# EasyEDA Pro project RCKid3.eprj, board RCKid (continued)
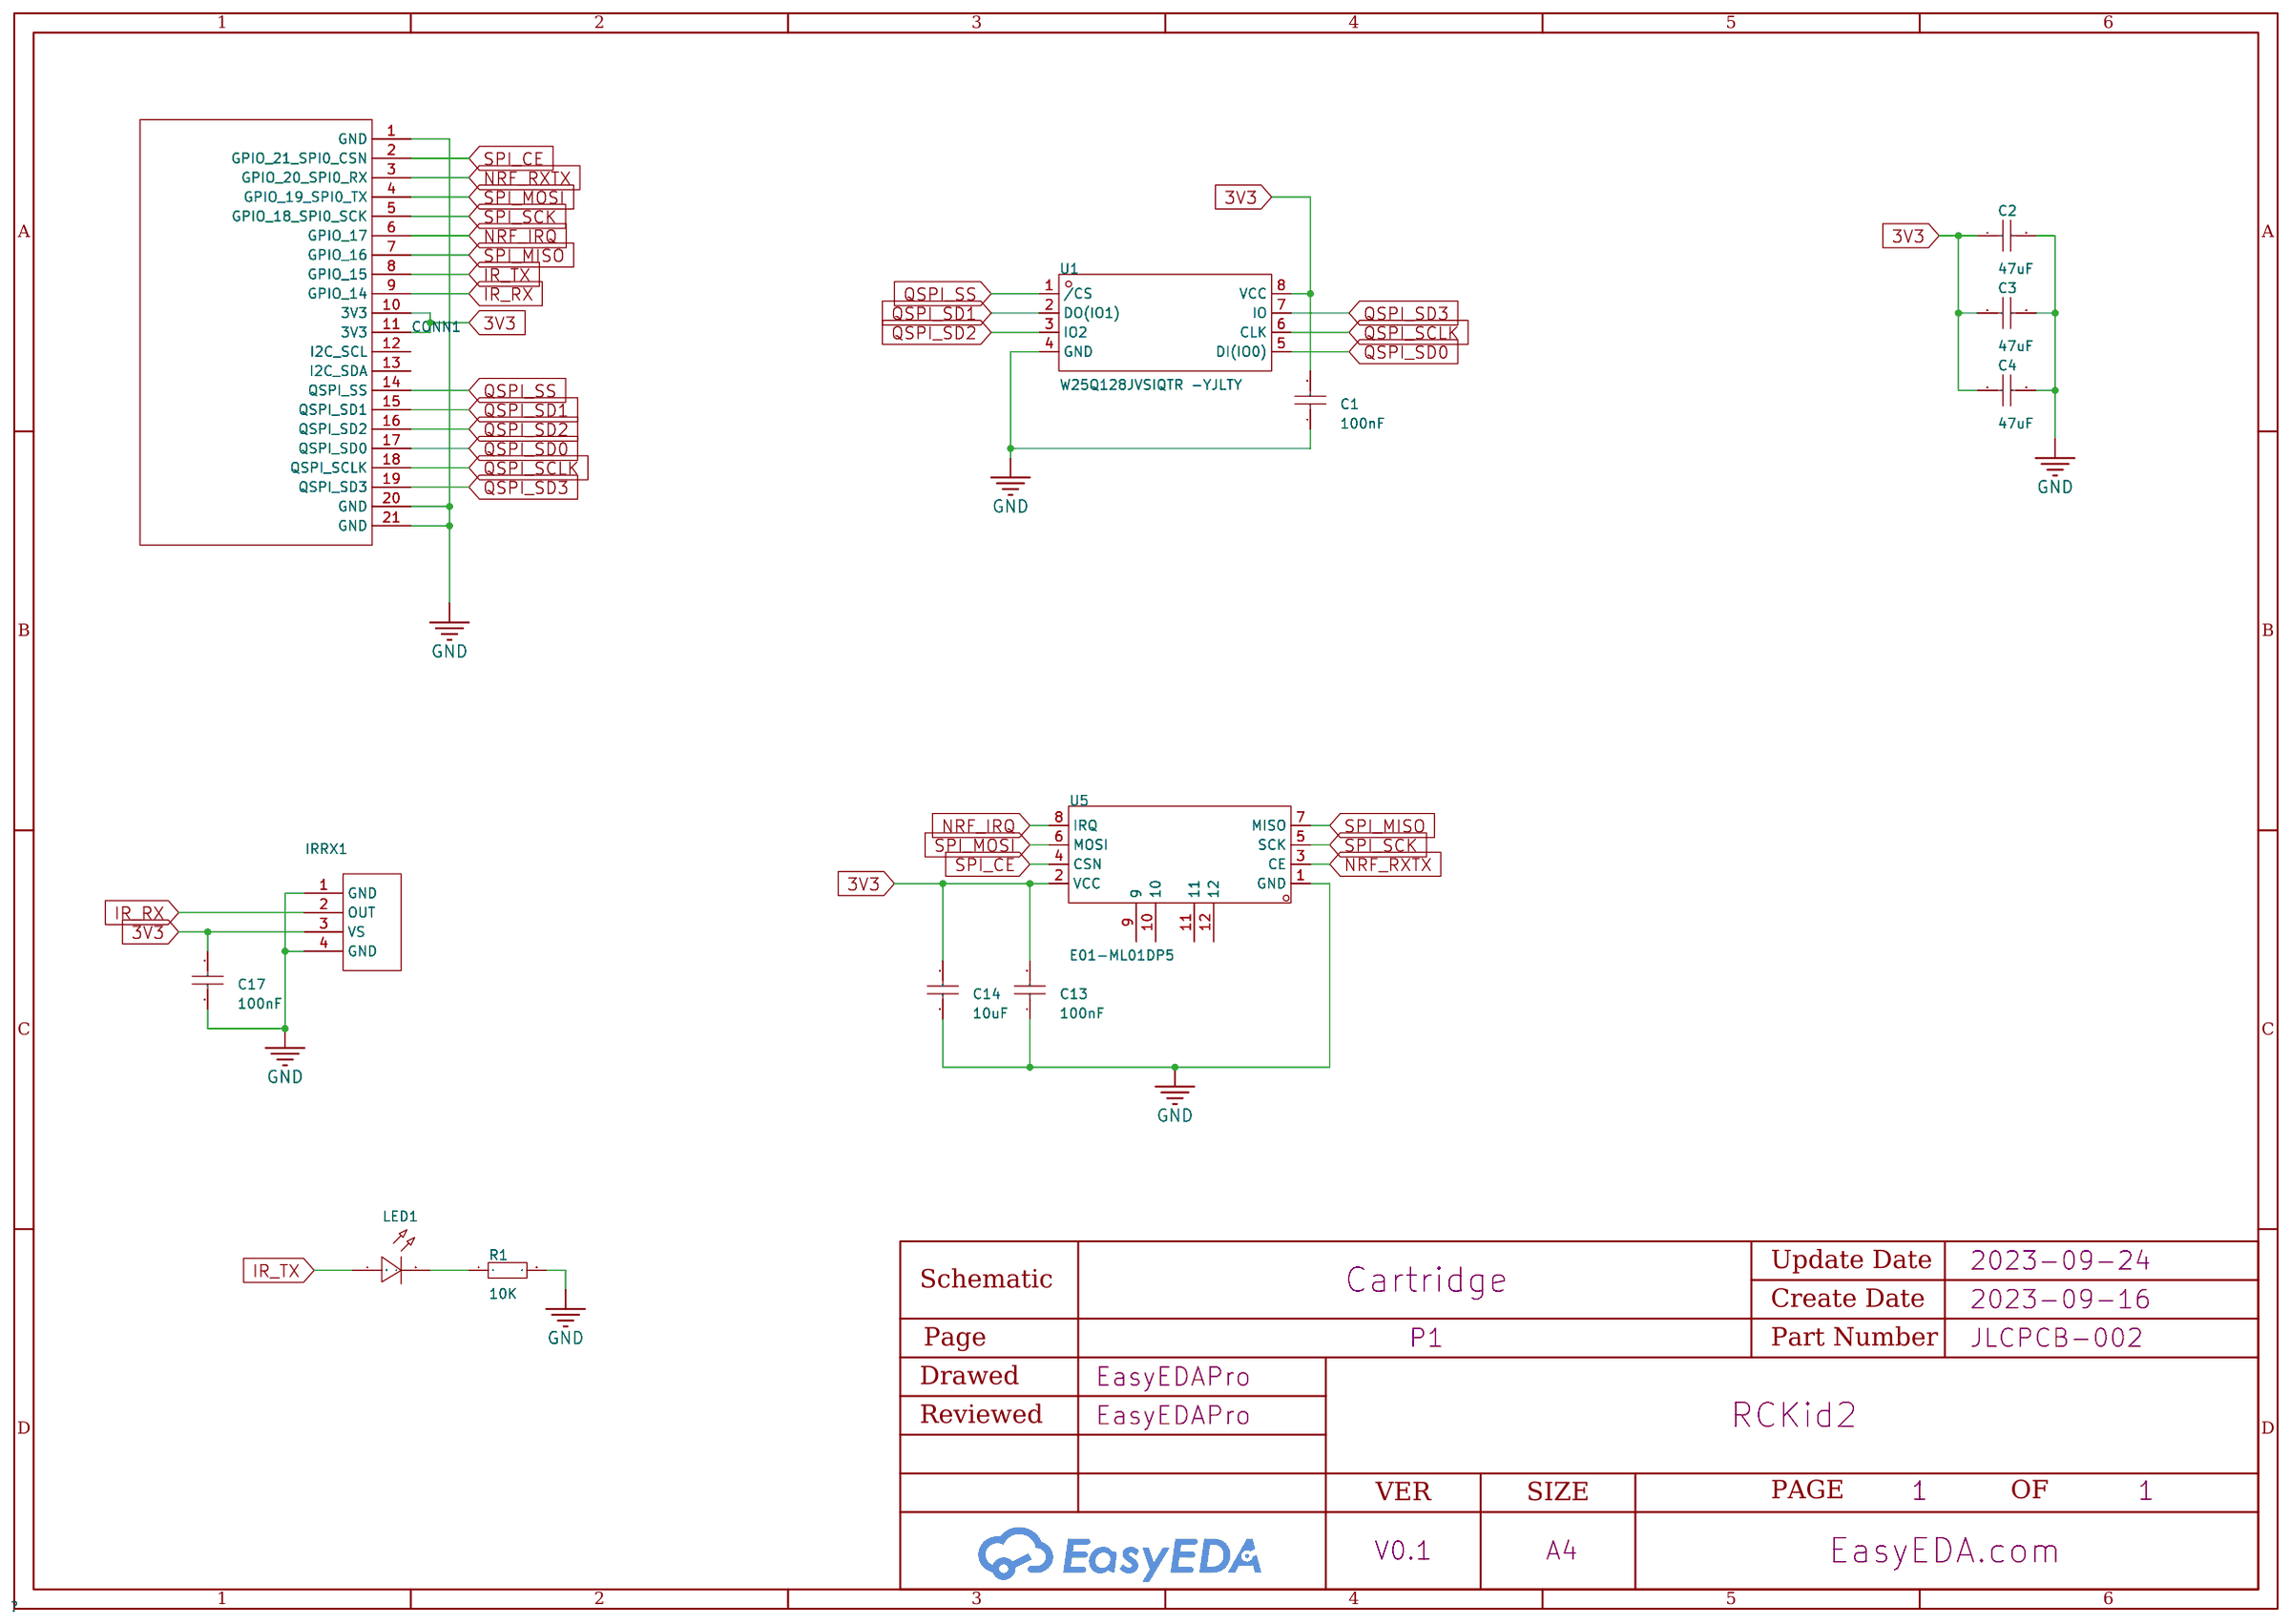
[diagram p0: NRF24L01P]
## Routing (per net, layer and track width the routed paths; a pad name or vN(x,y) marks a point on that pad's centre or on a via; arc(x,y) is an arc through that point) (continued)
  Bottom Layer w0.15: v1(63.7,38.89) 66,36.59 VOL_DOWN.2 ; VOL_UP.2 v1(63.7,42.99) 58.3,48.39 55.9,48.39 53.9,50.39 v1(44.5,50.39)
  Bottom Layer w0.2: v1(66,57.19) HOME1.1
BTN_DPAD: length 44.7
  Top Layer w0.15: AVR.19 30.65,49.44 30.2,49.89 26,49.89 v1(25.4,49.29) ; LEFT1.2 LEFT1.4
  Top Layer w0.2: RIGHT1.2 16.7,36.54 18.65,38.49 BOTTOM1.4 BOTTOM1.2 18.65,44.49 16.7,46.44 LEFT1.4 ; LEFT1.2 10.7,46.44 8.75,44.49 TOP1.4 TOP1.2 8.75,38.49 10.7,36.54 RIGHT1.4
  Bottom Layer w0.15: v1(25.4,49.29) 21.6,45.49 v1(17.7,45.49)
DB_0: length 60.7
  Top Layer w0.15: RP2350B.44 6.27,81.59 5.3,82.56 5.3,86.09 7.2,87.99 7.2,94.59 9.6,96.99 19.6,96.99 21.5,95.09 30.5,95.09 42.8,82.79 43.77,82.79 DISPLAY.24
DB_1: length 59.3
  Top Layer w0.15: RP2350B.43 6.43,81.99 5.7,82.72 5.7,85.69 7.8,87.79 7.8,94.39 10,96.59 19.2,96.59 21.3,94.49 30.3,94.49 42.55,82.24 DISPLAY.23
DB_2: length 57.9
  Top Layer w0.15: DISPLAY.22 42.25,81.74 30.1,93.89 21.1,93.89 18.8,96.19 10.4,96.19 8.4,94.19 8.4,87.59 6.1,85.29 6.1,82.89 6.6,82.39 RP2350B.42
DB_3: length 52.3
  Top Layer w0.15: RP2350B.40 10.4,84.39 9,85.79 9,93.99 10.8,95.79 18.4,95.79 20.9,93.29 29.9,93.29 41.95,81.24 DISPLAY.21
DB_4: length 51.3
  Top Layer w0.15: DISPLAY.20 41.65,80.74 29.7,92.69 20.7,92.69 18,95.39 11.2,95.39 9.6,93.79 9.6,85.76 10.8,84.56 RP2350B.39
DB_5: length 50.4
  Top Layer w0.15: DISPLAY.19 41.35,80.24 29.5,92.09 20.5,92.09 17.6,94.99 11.6,94.99 10.2,93.59 10.2,85.72 11.2,84.72 RP2350B.38
DB_6: length 49.5
  Top Layer w0.15: DISPLAY.18 41.05,79.74 29.3,91.49 20.3,91.49 17.2,94.59 12,94.59 10.8,93.39 10.8,85.69 11.6,84.89 RP2350B.37
DB_7: length 48.6
  Top Layer w0.15: RP2350B.36 12,85.05 11.4,85.65 11.4,93.19 12.4,94.19 16.8,94.19 20.2,90.79 29.2,90.79 40.75,79.24 DISPLAY.17
DB_8: length 37.3
  Top Layer w0.15: RP2350B.28 15.2,85.69 16.3,86.79 16.3,87.39 19,90.09 29.1,90.09 40.45,78.74 DISPLAY.16
DB_9: length 36.5
  Top Layer w0.15: DISPLAY.15 40.15,78.24 28.9,89.49 19,89.49 16.7,87.19 16.7,86.59 15.6,85.49 RP2350B.27
DB_10: length 35.7
  Top Layer w0.15: DISPLAY.14 39.85,77.74 28.7,88.89 18.97,88.89 17.1,87.02 17.1,86.39 16,85.29 RP2350B.26
DB_11: length 34.9
  Top Layer w0.15: DISPLAY.13 39.55,77.24 28.5,88.29 18.93,88.29 17.5,86.86 17.5,86.19 16.4,85.09 RP2350B.25
DB_12: length 33.2
  Top Layer w0.15: RP2350B.23 17.2,84.69 18.1,85.59 20.42,85.59 22.52,87.69 28.3,87.69 39.25,76.74 DISPLAY.12
DB_13: length 32.4
  Top Layer w0.15: DISPLAY.11 38.95,76.24 28.1,87.09 22.49,87.09 20.59,85.19 18.3,85.19 17.6,84.49 RP2350B.22
DB_14: length 31.6
  Top Layer w0.15: DISPLAY.10 38.65,75.74 27.9,86.49 22.45,86.49 20.75,84.79 18.5,84.79 18,84.29 RP2350B.21
DB_15: length 30.3
  Top Layer w0.15: DISPLAY.9 38.35,75.24 27.8,85.79 22.6,85.79 19.6,82.79 RP2350B.20
DISP_CSX: length 65.7
  Top Layer w0.15: DISPLAY.32 42.05,86.74 31.3,97.49 22.3,97.49 21.2,98.59 8,98.59 4.8,95.39 4.8,88.79 3.7,87.69 3.7,81.66 5.37,79.99 RP2350B.48
DISP_DCX: length 64.3
  Top Layer w0.15: DISPLAY.31 41.75,86.24 31.1,96.89 22.1,96.89 20.8,98.19 8.4,98.19 5.4,95.19 5.4,88.59 4.1,87.29 4.1,81.82 5.53,80.39 RP2350B.47
DISP_LED_K: length 8.3
  Top Layer w0.3: DISPLAY.5 45.92,73.24 46.42,73.74 ; DISPLAY.7 46.02,74.24 R84.1 46.42,73.74 ; 46.42,73.74 DISPLAY.6
DISP_RDX: length 61.4
  Top Layer w0.15: RP2350B.45 6,81.19 4.9,82.29 4.9,86.49 6.6,88.19 6.6,94.79 9.2,97.39 20,97.39 21.7,95.69 30.7,95.69 41.15,85.24 DISPLAY.29
DISP_TE: length 67.2
  Top Layer w0.15: DISPLAY.33 42.35,87.24 31.5,98.09 22.5,98.09 21.6,98.99 7.6,98.99 4.2,95.59 4.2,88.99 3.3,88.09 3.3,81.49 5.2,79.59 RP2350B.49
DISP_WRX: length 62.9
  Top Layer w0.15: RP2350B.46 5.7,80.79 4.5,81.99 4.5,86.89 6,88.39 6,94.99 8.8,97.79 20.4,97.79 21.9,96.29 30.9,96.29 41.45,85.74 DISPLAY.30
EMBEDDED_ANTENNA: length 22.4
  Top Layer w0.25: v1(47,7.49) 45.93,6.42 L19.1 45.7,3.87 FMA.1 ; v1(57.4,15.79) 57.52,15.91 RADIO.4
  Bottom Layer w0.25: v1(47,7.49) 48.3,7.49 49.1,8.29 49.1,13.89 51,15.79 v1(57.4,15.79)
GPIO_11: length 53.8
  Top Layer w0.15: RP2350B.9 21,78.39 21.3,78.09 25.2,78.09 25.4,77.89 arc(25.49,77.68) 25.4,77.47 25.07,77.14 arc(25.07,76.72) 25.5,76.72 25.82,77.04 arc(26.25,77.04) 26.25,76.62 25.92,76.29 arc(25.92,75.87) 26.35,75.87 26.67,76.19 arc(27.1,76.19) 27.1,75.77 26.77,75.44 arc(26.77,75.02) 27.2,75.02 27.52,75.34 arc(27.73,75.43) 27.95,75.34 28.1,75.19 28.1,74.79 arc(28.01,74.58) 27.8,74.49 27,74.49 arc(26.7,74.19) 27,73.89 27.9,73.89 arc(28.2,73.59) 27.9,73.29 27,73.29 arc(26.7,72.99) 27,72.69 27.9,72.69 arc(28.2,72.39) 27.9,72.09 27,72.09 arc(26.7,71.79) 27,71.49 27.9,71.49 arc(28.2,71.19) 27.9,70.89 27.6,70.89 arc(27.3,70.59) 27.6,70.29 27.8,70.29 arc(28.01,70.2) 28.1,69.99 28.1,69.69 33.5,64.29 34.35,64.29 arc(34.56,64.2) 34.65,63.99 34.65,63.79 arc(34.95,63.49) 35.25,63.79 35.25,63.99 arc(35.34,64.2) 35.55,64.29 35.88,64.29 36.15,64.03 arc(36.23,63.82) 36.15,63.6 35.68,63.14 arc(35.68,62.71) 36.1,62.71 37.37,63.98 arc(37.79,63.98) 37.79,63.55 36.88,62.64 arc(36.88,62.21) 37.3,62.21 38.32,63.23 arc(38.74,63.23) 38.74,62.81 37.73,61.79 arc(37.73,61.36) 38.15,61.36 38.27,61.48 arc(38.48,61.57) 38.69,61.48 CARTRIDGE.9
GPIO_12: length 53.8
  Top Layer w0.15: CARTRIDGE.8 41.21,61.5 arc(41.12,61.71) 41.21,61.93 41.63,62.34 arc(41.63,62.76) 41.2,62.76 40.44,62 arc(40.01,62) 40.01,62.42 40.78,63.19 arc(40.78,63.61) 40.35,63.61 39.94,63.2 arc(39.51,63.2) 39.51,63.62 39.93,64.04 arc(39.93,64.46) 39.5,64.46 39.09,64.05 arc(38.88,63.96) 38.67,64.05 37.92,64.79 33.9,64.79 30,68.69 30,68.99 arc(29.91,69.2) 29.7,69.29 29.4,69.29 arc(29.1,69.59) 29.4,69.89 29.7,69.89 arc(30,70.19) 29.7,70.49 29.2,70.49 arc(28.9,70.79) 29.2,71.09 29.7,71.09 arc(30,71.39) 29.7,71.69 29.1,71.69 arc(28.8,71.99) 29.1,72.29 29.7,72.29 arc(30,72.59) 29.7,72.89 29.1,72.89 arc(28.8,73.19) 29.1,73.49 29.7,73.49 arc(30,73.79) 29.7,74.09 29.1,74.09 arc(28.8,74.39) 29.1,74.69 29.7,74.69 arc(29.91,74.78) 30,74.99 30,75.59 29.25,76.34 arc(29.03,76.43) 28.82,76.34 28.55,76.07 arc(28.12,76.07) 28.12,76.49 28.4,76.77 arc(28.4,77.19) 27.97,77.19 27.7,76.92 arc(27.27,76.92) 27.27,77.34 27.55,77.62 arc(27.55,78.04) 27.12,78.04 26.85,77.77 arc(26.42,77.77) 26.42,78.19 26.7,78.47 arc(26.79,78.68) 26.7,78.89 26.4,79.19 RP2350B.11
GPIO_13: length 53.8
  Top Layer w0.15: RP2350B.12 25.7,79.59 26,79.89 26.6,79.89 31.9,74.59 31.9,74.19 arc(31.81,73.98) 31.6,73.89 31,73.89 arc(30.7,73.59) 31,73.29 31.6,73.29 arc(31.9,72.99) 31.6,72.69 31,72.69 arc(30.7,72.39) 31,72.09 31.6,72.09 arc(31.9,71.79) 31.6,71.49 31,71.49 arc(30.7,71.19) 31,70.89 31.6,70.89 arc(31.9,70.59) 31.6,70.29 31,70.29 arc(30.7,69.99) 31,69.69 31.6,69.69 arc(31.9,69.39) 31.6,69.09 31.2,69.09 arc(30.9,68.79) 31.2,68.49 31.6,68.49 arc(31.81,68.4) 31.9,68.19 31.9,67.69 34.3,65.29 39.96,65.29 40.34,64.92 arc(40.55,64.83) 40.76,64.92 41.11,65.26 arc(41.53,65.26) 41.53,64.84 41.19,64.49 arc(41.19,64.07) 41.61,64.07 41.95,64.41 arc(42.38,64.41) 42.38,63.99 42.03,63.64 arc(42.03,63.22) 42.46,63.22 42.8,63.56 arc(43.23,63.56) 43.23,63.14 42.53,62.44 arc(42.53,62.02) 42.96,62.02 43.65,62.71 arc(44.08,62.71) 44.08,62.29 43.73,61.95 arc(43.64,61.73) 43.73,61.52 CARTRIDGE.7
GPIO_14: length 53.8
  Top Layer w0.15: CARTRIDGE.6 46.3,61.49 arc(46.21,61.7) 46.3,61.92 46.68,62.29 arc(46.68,62.71) 46.25,62.71 45.68,62.14 arc(45.25,62.14) 45.25,62.56 45.83,63.14 arc(45.83,63.56) 45.4,63.56 45.03,63.19 arc(44.6,63.19) 44.6,63.61 44.98,63.99 arc(44.98,64.41) 44.55,64.41 44.18,64.04 arc(43.76,64.04) 43.76,64.46 44.13,64.84 arc(44.13,65.26) 43.71,65.26 43.33,64.89 arc(42.91,64.89) 42.91,65.31 42.93,65.33 arc(42.93,65.76) 42.51,65.76 42.48,65.73 arc(42.27,65.65) 42.06,65.73 42,65.79 34.7,65.79 33.4,67.09 33.4,67.69 arc(33.31,67.9) 33.1,67.99 32.9,67.99 arc(32.6,68.29) 32.9,68.59 33.1,68.59 arc(33.4,68.89) 33.1,69.19 32.9,69.19 arc(32.6,69.49) 32.9,69.79 33.1,69.79 arc(33.4,70.09) 33.1,70.39 32.9,70.39 arc(32.6,70.69) 32.9,70.99 33.1,70.99 arc(33.4,71.29) 33.1,71.59 32.9,71.59 arc(32.6,71.89) 32.9,72.19 33.1,72.19 arc(33.4,72.49) 33.1,72.79 32.9,72.79 arc(32.6,73.09) 32.9,73.39 33.1,73.39 arc(33.31,73.48) 33.4,73.69 33.4,73.99 26.8,80.59 25.8,80.59 25.2,79.99 RP2350B.13
GPIO_15: length 53.8
  Top Layer w0.15: CARTRIDGE.5 48.82,61.51 arc(48.73,61.72) 48.82,61.94 49.23,62.34 arc(49.23,62.76) 48.8,62.76 48.4,62.36 arc(47.97,62.36) 47.97,62.78 48.38,63.19 arc(48.38,63.61) 47.95,63.61 47.55,63.21 arc(47.12,63.21) 47.12,63.63 47.53,64.04 arc(47.53,64.46) 47.1,64.46 46.7,64.06 arc(46.28,64.06) 46.28,64.48 46.68,64.89 arc(46.68,65.31) 46.26,65.31 45.85,64.91 arc(45.43,64.91) 45.43,65.33 45.83,65.73 arc(45.83,66.16) 45.41,66.16 45,65.75 arc(44.79,65.67) 44.58,65.75 44.04,66.29 35.3,66.29 34.4,67.19 34.4,67.99 arc(34.36,68.09) 34.25,68.14 arc(34.14,68.18) 34.1,68.29 34.1,68.59 arc(34.14,68.69) 34.25,68.74 arc(34.36,68.78) 34.4,68.89 34.4,69.19 arc(34.36,69.29) 34.25,69.34 arc(34.14,69.38) 34.1,69.49 34.1,69.79 arc(34.14,69.89) 34.25,69.94 arc(34.36,69.98) 34.4,70.09 34.4,70.39 arc(34.36,70.49) 34.25,70.54 arc(34.14,70.58) 34.1,70.69 34.1,70.99 arc(34.14,71.09) 34.25,71.14 arc(34.36,71.18) 34.4,71.29 34.4,71.59 arc(34.36,71.69) 34.25,71.74 arc(34.14,71.78) 34.1,71.89 34.1,72.19 arc(34.14,72.29) 34.25,72.34 arc(34.36,72.38) 34.4,72.49 34.4,72.79 arc(34.36,72.89) 34.25,72.94 arc(34.14,72.98) 34.1,73.09 34.1,73.39 arc(34.14,73.49) 34.25,73.54 arc(34.36,73.58) 34.4,73.69 34.4,73.89 27,81.29 25.6,81.29 24.7,80.39 RP2350B.14
GPIO_16: length 53.9
  Top Layer w0.15: CARTRIDGE.4 51.29,61.58 arc(51.2,61.79) 51.29,62.01 51.68,62.39 arc(51.68,62.81) 51.25,62.81 50.87,62.43 arc(50.44,62.43) 50.44,62.85 50.78,63.19 arc(50.78,63.61) 50.35,63.61 50.02,63.28 arc(49.59,63.28) 49.59,63.7 49.93,64.04 arc(49.93,64.46) 49.5,64.46 49.17,64.13 arc(48.75,64.13) 48.75,64.55 49.08,64.89 arc(49.08,65.31) 48.66,65.31 48.32,64.98 arc(47.9,64.98) 47.9,65.4 48.23,65.73 arc(48.23,66.16) 47.81,66.16 47.47,65.82 arc(47.05,65.82) 47.05,66.25 arc(47.05,66.67) 46.62,66.67 arc(46.41,66.58) 46.2,66.67 46.08,66.79 37.1,66.79 35.1,68.79 35.1,74.09 27.2,81.99 21.8,81.99 21,81.19 RP2350B.16
GPIO_17: length 53.6
  Top Layer w0.15: RP2350B.17 20.7,81.59 21.8,82.69 27.4,82.69 35.8,74.29 35.8,68.99 37.5,67.29 48.12,67.29 49.57,65.84 arc(49.78,65.76) 49.99,65.84 50.16,66.01 arc(50.58,66.01) 50.58,65.58 50.42,65.42 arc(50.42,65) 50.84,65 51.01,65.16 arc(51.43,65.16) 51.43,64.74 51.27,64.57 arc(51.27,64.15) 51.69,64.15 51.85,64.31 arc(52.28,64.31) 52.28,63.89 52.11,63.72 arc(52.11,63.3) 52.54,63.3 52.7,63.46 arc(53.13,63.46) 53.13,63.04 52.96,62.87 arc(52.96,62.45) 53.39,62.45 53.55,62.61 arc(53.98,62.61) 53.98,62.19 53.81,62.03 arc(53.72,61.81) 53.81,61.6 CARTRIDGE.3
GPIO_18: length 53.7
  Top Layer w0.15: CARTRIDGE.2 56.06,61.89 arc(55.97,62.1) 56.06,62.31 56.36,62.61 arc(56.36,63.03) 55.93,63.03 55.64,62.74 arc(55.21,62.74) 55.21,63.16 55.46,63.41 arc(55.46,63.83) 55.03,63.83 54.79,63.59 arc(54.58,63.5) 54.36,63.59 50.16,67.79 37.9,67.79 36.5,69.19 36.5,74.49 27.6,83.39 21.8,83.39 20.4,81.99 RP2350B.18
GPIO_19: length 53.8
  Top Layer w0.15: RP2350B.19 20.1,82.39 21.8,84.09 27.8,84.09 37.2,74.69 37.2,69.39 38.3,68.29 52,68.29 59.3,60.99 CARTRIDGE.1
GPIO_47: length 16.2
  Top Layer w0.15: v1(7.94,75.09) 7.94,75.13 8.8,75.99 RP2350B.58
  Bottom Layer w0.15: CARTRIDGE.21 8.7,64.39 7.94,65.15 v1(7.94,75.09)
HEADSET_ANTENNA: length 8.7
  Top Layer w0.25: RADIO.2 56.52,15.37 57,14.89 59.3,14.89 60.2,13.99 C242.2
HEADSET_DETECT: length 47.1
  Top Layer w0.15: v1(56.4,36.89) 57.82,36.89 AUDIO.8 ; 60.7,29.05 59.95,29.05 v1(59.9,29.09) ; v1(53.2,22.69) 51.5,20.99 51.5,17.59 v1(49.6,15.69) ; v1(55.3,33.49) 54.9,33.09 54.9,32.62
  Top Layer w0.2: v1(48.2,9.19) 48.2,6.09 HEADSET.2
  Bottom Layer w0.15: v1(56.4,36.89) 55.3,35.79 v1(55.3,33.49) 56.7,32.09 59.4,32.09 59.9,31.59 v1(59.9,29.09) 59.9,27.95 58.54,26.59 54.7,26.59 53.2,25.09 v1(53.2,22.69)
  Bottom Layer w0.2: v1(49.6,15.69) 48.2,14.29 v1(48.2,9.19)
HEADSET_LEFT: length 33.3
  Top Layer w0.25: AUDIO.25 62.15,32.74 v1(62.7,32.19) ; C199.2 46.7,15.49 47.7,16.49 v1(48.9,16.49)
  Bottom Layer w0.25: v1(48.9,16.49) 60.7,16.49 62.2,17.99 62.2,30.69 62.7,31.19 v1(62.7,32.19)
HEADSET_MIC: length 2.1
  Top Layer w0.15: AUDIO.21 59.85,31.14 60.55,30.44 60.7,30.44
HEADSET_RIGHT: length 27.8
  Top Layer w0.25: v1(64.3,9.39) 64.3,7.5 C200.2 ; AUDIO.27 62.85,33.74 v1(62.9,33.69)
  Bottom Layer w0.25: v1(62.9,33.69) 63.4,33.19 63.4,30.28 63.24,30.12 63.24,10.45 v1(64.3,9.39)
I2C_SCL: length 61.7
  Top Layer w0.15: v1(31.2,52.49) 31.83,52.49 U41.4 32.15,52.54 32.75,51.94 32.75,50.22 ; PWR.5 11.45,18.54 v1(11.7,18.29) ; U26.13 26.5,39.19 26.1,39.59 26.1,40.66 v1(26.97,41.53) ; U40.2 26.35,52.94 v1(26.6,52.69) ; R45.1 28.2,45.42 v1(28.2,46.29) v1(27,46.29)
  Bottom Layer w0.15: v1(28.2,46.29) 28.2,50.79 29.9,52.49 v1(31.2,52.49) ; v1(26.6,52.69) 27,52.29 v1(27,46.29) 27,32.89 17.8,23.69 17.8,22.49 TP7.1 16.68,21.47 13.5,18.29 v1(11.7,18.29)
I2C_SCL_VDD: length 106.2
  Top Layer w0.15: 25.2,51.49 U40.10 ; v1(53.9,36.49) v1(54.8,37.39) 55.95,36.24 AUDIO.9 ; RADIO.7 60.24,17.35 v1(60.4,17.19) ; RP2350B.78 17.2,73.19 17.6,72.79 18.3,72.79 21,70.09 21,68.79 25.3,64.49 25.3,58.39 v1(26.2,57.49) 27.3,56.39 29.5,56.39 30.6,55.29 33.4,55.29 33.8,54.89 46.8,54.89 49.1,52.59 49.1,41.09 v1(49.8,40.39)
  Bottom Layer w0.15: v1(53.9,36.49) 50.5,33.09 50.5,20.69 54.1,17.09 60.3,17.09 v1(60.4,17.19) ; v1(49.8,40.39) 51.4,38.79 53.4,38.79 v1(54.8,37.39) ; v1(25.2,51.49) 25.3,51.59 25.3,56.59 v1(26.2,57.49)
I2C_SDA: length 60.9
  Top Layer w0.15: v1(27.6,36.59) 26.9,37.29 26.9,38.59 27,38.69 U26.14 ; PWR.6 11.95,19.24 12.6,18.59 v1(12.6,17.69) ; v1(26.6,54.39) 26.5,54.39 26.05,53.94 U40.4 ; v1(31.2,53.79) 31.83,53.79 U41.6 32.45,53.84 33.25,53.04 33.25,50.22 ; R46.1 28.23,43.62 27.9,43.29 v1(27.6,43.29)
  Bottom Layer w0.15: 27.6,53.39 v1(27.6,43.29) v1(27.6,36.59) 27.6,32.59 19,23.99 19,21.39 17.4,19.79 15.9,19.79 13.8,17.69 v1(12.6,17.69) ; 27.6,53.39 28,53.79 v1(31.2,53.79) ; 27.6,53.39 v1(26.6,54.39)
I2C_SDA_VDD: length 101.1
  Top Layer w0.15: 25.3,55.69 24.6,56.39 24.6,58.09 25,58.49 25,64.19 20.5,68.69 20.5,69.99 18.2,72.29 17.4,72.29 16.8,72.89 RP2350B.77 ; 25.3,55.69 29.3,55.69 30.3,54.69 33.1,54.69 33.5,54.29 46.5,54.29 48.5,52.29 48.5,40.79 v1(49.1,40.19) ; 25.3,55.69 24.56,54.95 U40.6 24.6,53.98 ; v1(60.4,18.09) 60.16,17.85 RADIO.8 ; AUDIO.10 55.55,35.74 v1(54.8,36.49)
  Bottom Layer w0.15: v1(60.4,18.09) 54,18.09 51.1,20.99 51.1,32.79 v1(54.8,36.49) 53.1,38.19 51.1,38.19 v1(49.1,40.19)
I2S_BCK: length 70.3
  Top Layer w0.15: AUDIO.2 60.85,39.54 58.1,42.29 54.2,42.29 53.3,43.19 53.3,54.79 49,59.09 35.9,59.09 35.1,59.89 35.1,61.49 33.5,63.09 32.9,63.09 25.5,70.49 25.5,74.69 23.4,76.79 21.4,76.79 20.6,77.59 RP2350B.7
I2S_DIN: length 67.3
  Top Layer w0.15: AUDIO.4 59.85,38.74 57.5,41.09 53.6,41.09 52.1,42.59 52.1,54.09 48.3,57.89 35.3,57.89 34.9,58.29 34,58.29 32.6,59.69 32.6,61.59 24.3,69.89 24.3,72.09 20,76.39 RP2350B.4
I2S_DOUT: length 67.7
  Top Layer w0.15: RP2350B.3 19.9,75.99 20.5,75.39 20.5,75.09 23.7,71.89 23.7,69.59 30.5,62.79 30.5,58.99 31.8,57.69 34.6,57.69 35,57.29 48,57.29 51.5,53.79 51.5,42.29 53.3,40.49 57.2,40.49 59.35,38.34 AUDIO.5
I2S_LRCK: length 69.7
  Top Layer w0.15: RP2350B.6 20.4,77.19 21.4,76.19 23.3,76.19 24.9,74.59 24.9,70.19 33.1,61.99 33.1,60.09 34.3,58.89 35.2,58.89 35.6,58.49 48.7,58.49 52.7,54.49 52.7,42.89 53.9,41.69 57.8,41.69 60.35,39.14 AUDIO.3
IOVDD: length 66.9
  Top Layer w0.15: 38.9,35.19 38.8,35.29 38.8,36.39 ; R76.1 v1(49,87.59) ; 38.9,36.39 v1(40.5,36.39)
  Top Layer w0.2: 13.4,71.69 13.2,71.89 RP2350B.68 ; 13.4,71.69 13.6,71.89 RP2350B.69 ; 13.4,71.69 C167.2 ; 22.41,75.28 22.1,75.59 21.4,75.59 20.2,76.79 RP2350B.5 ; RP2350B.29 14.8,85.99 15.2,86.39 15.2,87.15 ; C116.2 6.14,74.59 8.3,74.59 8.9,75.19 RP2350B.60 ; RP2350B.41 7.45,82.79 C111.2 ; RP2350B.76 16.4,72.59 17.3,71.69 17.6,71.69 C108.2 ; C110.2 6.14,79.19 RP2350B.50 ; C112.2 21.8,81.19 21.4,80.79 RP2350B.15 ; RP2350B.24 16.8,84.89 18.36,86.45 18.36,86.49
  Top Layer w0.25: 58.7,21.14 C236.2 58.64,21.19 58.7,21.14 ; 58.7,21.14 58.7,21.14 58.7,20.29 58.52,20.11 RADIO.11 ; 58.7,21.14 58.72,21.17 v1(58.72,21.81) 58.72,22.39 ; AUDIO.26 62.55,33.24 62.7,33.09 64.05,33.09 C191.2 C192.2 ; v1(57.4,39.29) 57.4,38.54 C209.2 58.1,38.49 58.85,37.74 AUDIO.6 ; 58.45,22.39 58.64,22.39 ; 58.64,22.39 58.72,22.39 ; 58.64,22.39 C237.1 58.72,22.41 58.72,22.39 ; RADIO.10 59.16,18.85 59.6,19.29 59.6,21.99 59.2,22.39 58.72,22.39 ; C192.2 v1(65.1,32.19) ; C192.2 C204.1 ; 64.9,24.09 65.4,23.59 65.4,23.09 v1(66.2,22.29) ; AUDIO.30 62.95,35.24 v1(63.2,35.49)
  Top Layer w0.4: microSD.4 51.7,90.99 51.3,90.59 C132.2
  Top Layer w0.5: v1(36.3,33.49) v1(36.3,32.79) 36.3,32.29 35.9,31.89 34.5,31.89 34.5,29.39 ; C132.2 v1(49,90.59)
  vias: v1(24,57.69) v1(40.7,42.39) v1(40.7,41.69) v1(40.7,40.99) v1(41.4,42.39) v1(41.4,41.69) v1(41.4,40.99)
